# Altium schematic sheet ProbadorDeCables_Accesorios_B_MolexDe6.SchDoc
size A4
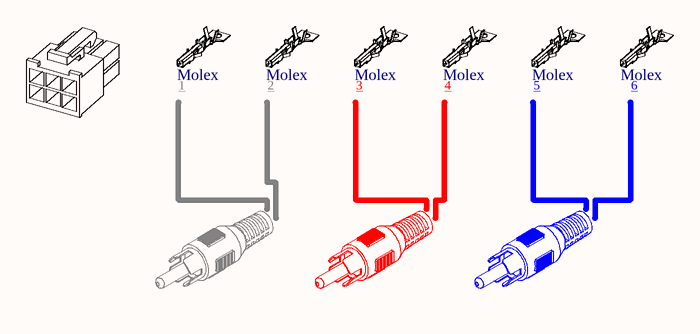
[diagram p0: ProbadorDeCables_Accesorios_B_MolexDe6.SchDoc]

## Parts
B_MOLEX  Molex 6 vias 0.165  [BOM_Molex-6vias-0-165]  (value not drawn)  (mechanical)
BOM_B_MOLEX__1  RCP-023__Blanco  [BOM_RCP-023__Blanco]  (value not drawn)  (mechanical)
BOM_B_MOLEX__2  RCP-022__Rojo  [BOM_RCP-022__Rojo]  (value not drawn)  (mechanical)
BOM_B_MOLEX__3  RCP-025__Azul  [BOM_RCP-025__Azul]  (value not drawn)  (mechanical)
BOM_B_MOLEX__4  ParaHousing: Molex  [BOM_sock_Molex_1586317-1]  (hidden comment: sock_Molex_1586317-1)  (mechanical)
BOM_B_MOLEX__5  ParaHousing: Molex  [BOM_sock_Molex_1586317-1]  (hidden comment: sock_Molex_1586317-1)  (mechanical)
BOM_B_MOLEX__6  ParaHousing: Molex  [BOM_sock_Molex_1586317-1]  (hidden comment: sock_Molex_1586317-1)  (mechanical)
BOM_B_MOLEX__7  ParaHousing: Molex  [BOM_sock_Molex_1586317-1]  (hidden comment: sock_Molex_1586317-1)  (mechanical)
BOM_B_MOLEX__8  ParaHousing: Molex  [BOM_sock_Molex_1586317-1]  (hidden comment: sock_Molex_1586317-1)  (mechanical)
BOM_B_MOLEX__9  ParaHousing: Molex  [BOM_sock_Molex_1586317-1]  (hidden comment: sock_Molex_1586317-1)  (mechanical)

## Notes on the sheet
- 1
- 2
- 3
- 4
- 5
- (near BOM_B_MOLEX__9) 6

## Library data of the parts
B_MOLEX = Molex 6 vias 0.165: CONN RECEPT 6POS FREE HANGING; Cod.Fabricante: 794954-6; Fabricante: TE Connectivity AMP Connectors; Cod.DigiKey: A30592-ND; ComponentLink1Description: Manufacturer Link; ComponentLink1URL: https://www.te.com/commerce/DocumentDelivery/DDEController?Action=srchrtrv&DocNm=794954&DocType=Customer+Drawing&DocLang=English; DIGIKEYx50: 0.16520; DIGIKEYx100: 0.15330
BOM_B_MOLEX__1 = RCP-023__Blanco: CONN RCA PLUG MONO 2COND; Fabricante: CUI Devices; Cod.DigiKey: CP-1455-ND; Cod.Fabricante: RCP-023; ComponentLink1Description: Manufacturer Link; ComponentLink1URL: https://www.cuidevices.com/product/resource/digikeypdf/rcp-02x.pdf; DIGIKEYx50: 1.09940; DIGIKEYx100: 1.05160
BOM_B_MOLEX__2 = RCP-022__Rojo: CONN RCA PLUG MONO 2COND; Fabricante: CUI Devices; Cod.DigiKey: CP-1454-ND; Cod.Fabricante: RCP-022; ComponentLink1Description: Manufacturer Link; ComponentLink1URL: https://www.cuidevices.com/product/resource/digikeypdf/rcp-02x.pdf; DIGIKEYx50: 1.09940; DIGIKEYx100: 1.05160
BOM_B_MOLEX__3 = RCP-025__Azul: CONN RCA PLUG MONO 2COND; Fabricante: CUI Devices; Cod.DigiKey: CP-1457-ND; Cod.Fabricante: RCP-025; ComponentLink1Description: Manufacturer Link; ComponentLink1URL: https://www.cuidevices.com/product/resource/digikeypdf/rcp-02x.pdf; DIGIKEYx50: 1.09940; DIGIKEYx100: 1.05160
BOM_B_MOLEX__4-BOM_B_MOLEX__9 = sock_Molex_1586317-1: CONN SOCKET 22-26AWG CRIMP TIN; Fabricante: TE Connectivity AMP Connectors; Cod.DigiKey: A30638-ND; Cod.Fabricante: 1586317-1; ComponentLink1Description: Manufacturer Link; ComponentLink1URL: https://www.te.com/commerce/DocumentDelivery/DDEController?Action=srchrtrv&DocNm=1586317&DocType=Customer+Drawing&DocLang=English; DIGIKEYx50: 0.05620